# Altium schematic sheet Modules.SchDoc: Screen, LED and IR
size A4; SheetNumber: 6; SheetTotal: 7
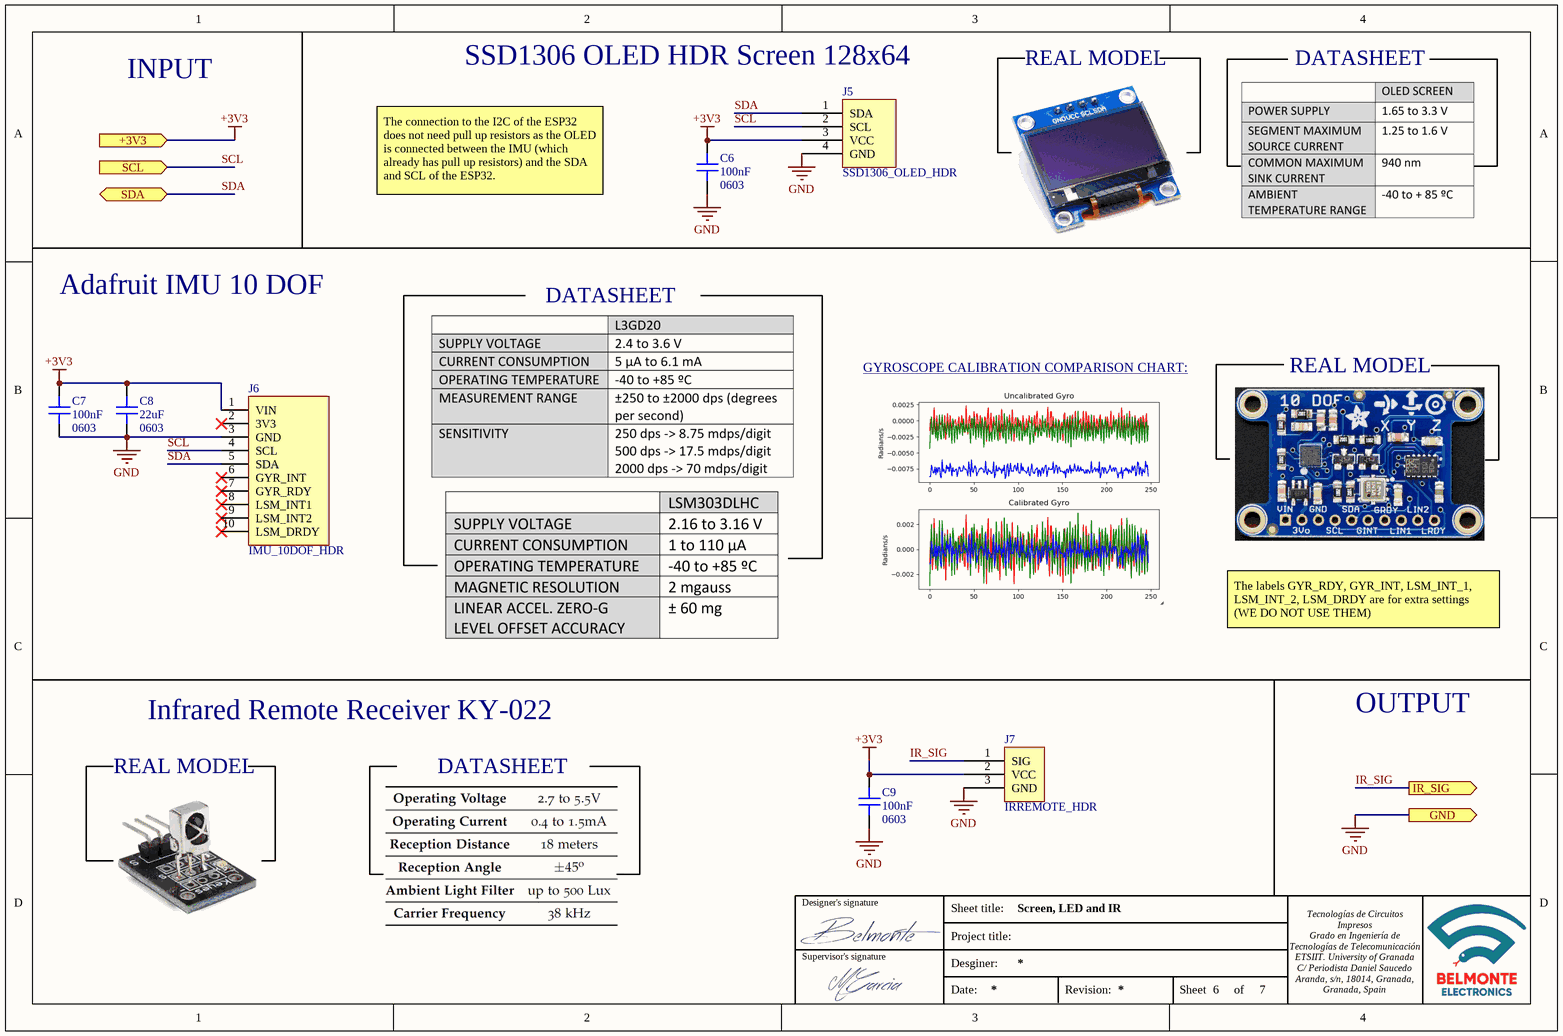
[diagram p0: Modules.SchDoc]

## Parts
C6  100nF  Size: 0603  [FP-GRM18-0_1-MFG]
C7  100nF  Size: 0603  [FP-GRM18-0_1-MFG]
C8  22uF  Size: 0603  [CAP 0603_1608]
C9  100nF  Size: 0603  [FP-GRM18-0_1-MFG]
J5  SSD1306_OLED_HDR  [OLED_guarreta]
J6  IMU_10DOF_HDR  [IMU_GUARRETA]
J7  IRREMOTE_HDR  [IRremote_guarreta]

## Ports
+3V3 (in), GND (out), IR_SIG (out), SCL (in), SDA (bidir)

## Nets
+3V3: C6.1 C7.1 C8.2 C9.1 J5.3(VCC) J6.1(VIN) J7.2(VCC) ; port +3V3
GND: C6.2 C7.2 C8.1 C9.2 J5.4(GND) J6.3(GND) J7.3(GND) ; port GND
IR_SIG: J7.1(SIG) ; port IR_SIG
SCL: J5.2(SCL) J6.4(SCL) ; port SCL
SDA: J5.1(SDA) J6.5(SDA) ; port SDA

Not connected (* = marked no-connect by the designer): J6 2(3V3)* 6(GYR_INT)* 7(GYR_RDY)* 8(LSM_INT1)* 9(LSM_INT2)* 10(LSM_DRDY)*

## Notes on the sheet
- INPUT
- (near J5) SSD1306 OLED HDR Screen 128x64
- REAL MODEL
- DATASHEET
- The connection to the I2C of the ESP32 does not need pull up resistors as the OLED is connected between the IMU (which already has pull up resistors) and the SDA and SCL of the ESP32.
- Adafruit IMU 10 DOF
- GYROSCOPE CALIBRATION COMPARISON CHART: <The chart comparing the calibrated and uncalibrated gyro has been taken from https://learn.adafruit.com/adafruit-sensorlab-gyroscope-calibration?view=all>
- The labels GYR_RDY, GYR_INT, LSM_INT_1, LSM_INT_2, LSM_DRDY are for extra settings (WE DO NOT USE THEM)
- OUTPUT
- Infrared Remote Receiver KY-022
- Designer's signature
- Sheet title:
- Supervisor's signature
- Project title:
- Desginer:
- Date:
- Revision:
- Sheet
- of
- Tecnologías de Circuitos Impresos
  Grado en Ingeniería de Tecnologías de Telecomunicación
  ETSIIT. University of Granada
  C/ Periodista Daniel Saucedo Aranda, s/n, 18014, Granada, Granada, Spain

## Library data of the parts
C6 C7 C9 = CMP-2006-02826-2: CAP CER 0.1UF 6.3V X7R 0603; Manufacturer Part Number: GRM188R70J104KA01D; Manufacturer: Murata; Symbol 0 0: Capacitor; Material: Ceramic; Value: 0.1 µF; Tolerance: 10%; Temperature Coefficient: 15%; Octopart: https://octopart.com/grm188r70j104ka01d-murata-17826949; Temperature: -55°C to +125°C; Ipc Land Pattern Name: CAPC16080X80; Lead Free: Yes; RoHS: TRUE; Device Class L2: Capacitors; Voltage Rating: 6.3V; Device Class L1: Passive Components; Package: GRM18-0.1; ComponentLink2URL: http://search.murata.co.jp/Ceramy/image/img/A01X/G101/ENG/GRM188R70J104KA01-01.pdf; Temperature Range Low: -55°C; Mouser Description: Multilayer Ceramic Capacitors MLCC - SMD/SMT 0.1uF 6.3Volts X7R 10%; ComponentLink2Description: Datasheet; Digikey Description: CAP CER 0.1UF 6.3V X7R 0603; Automotive: No; Height: 0.9mm; Voltage: 6.3V; Temperature Characteristic: X7R; Capacitance: 0.1uF; Device Class L3: Ceramic Capacitors; Category: Cap; Temperature Range High: +125°C
C8 = C1608X5R0G226M080AA: CAP CER 22UF 4V X5R 0603; Manufacturer: TDK Corporation; Capacitance: 22µF; Tolerance: ±20%; Value: 22 µF; Part Number: C1608X5R0G226M080AA; Applications: General Purpose; ComponentLink1Description: Datasheet; ComponentLink1URL: https://product.tdk.com/info/en/catalog/datasheets/mlcc_commercial_general_en.pdf?ref_disty=digikey; ComponentLink2Description: DigiKey Link; ComponentLink2URL: http://digikey.com/product-detail/en/tdk-corporation/C1608X5R0G226M080AA/445-8030-1-ND/2792156; Device Package: 0603 (1608 Metric); LastUpdated: 09/02/2020 01:03:35; Lifecycle Status: Active; Minimum Order: 1; Mounting Type: Surface Mount, MLCC; Operating Temperature: -55°C ~ 85°C; Package / Case: 0603 (1608 Metric); Packaging: TapeAndReel; PartId: 2599; Part Status: Active; Price: 0.09; Series: C; Size / Dimension: 0.063" L x 0.031" W (1.60mm x 0.80mm); Supplier 1: DigiKey; Supplier Part Number 1: 445-8030-1-ND; Temperature Coefficient: X5R; Thickness (Max): 0.039" (1.00mm); Voltage - Rated: 4V; Category: Cap
J5 = SSD_GUARRETA: CONN HDR 4POS 0.1 TIN PCB; Manufacturer: Sullins; Manufacturer Part Number: PPTC041LFBN-RC; Number of Positions: 4; Connector Type: Header,Socket; Pitch: 0.1inch; Supplier 1: Digi-Key; RoHS: Yes; Category: OLED Screen; Stock 1: 41925; Pricing 1: 1=0,45000, 10=0,42400, 100=0,32500, 500=0,28260, 1000=0,23315, 5000=0,20489, 10000=0,20410 (USD); Mount: Through Hole; Contact Plating: Tin; Contact Material: Bronze; Color: Black; Housing Material: Plastic; Termination: Solder; Package Quantity: 1000; Number of Rows: 1; Packaging: Bulk; Length: 10.7mm; Width: 2.5mm; Height: 8.5mm; Lead Free: Lead Free; ComponentLink1URL: https://media.digikey.com/pdf/Data%20Sheets/Sullins%20PDFs/Female_Headers.100_DS.pdf?src-supplier=Digi-Key; ComponentLink1Description: https://media.digikey.com/pdf/Data%20Sheets/Sullins%20PDFs/Female_Headers.100_DS.pdf?src-supplier=Digi-Key; ComponentLink2URL: http://www.sullinscorp.com/catalogs/78_Page80-81_HEADER_.100_2.54mm_FEMALE.pdf?src-supplier=Future+Electronics; ComponentLink2Description: http://www.sullinscorp.com/catalogs/78_Page80-81_HEADER_.100_2.54mm_FEMALE.pdf?src-supplier=Future+Electronics; Supplier Part Number 1: S7002-ND
J6 = IMU_GUARRETA: CONN HDR 10POS 0.1 TIN PCB; Manufacturer: Sullins; Manufacturer Part Number: PPTC101LFBN-RC; Number of Positions: 10; Connector Type: Header; Pitch: 0.1inch; Supplier 1: Digi-Key; RoHS: Yes; Category: IMU; Stock 1: 12464; Pricing 1: 1=0,65000, 10=0,57400, 100=0,49500, 500=0,40500, 1000=0,36000, 5000=0,32500 (USD); Mount: Through Hole; Color: Black; Contact Plating: Tin; Contact Material: Bronze; Housing Material: Plastic; Package Quantity: 1000; Number of Rows: 1; Packaging: Bulk; Termination: Solder; Contact Type: Female Socket; Length: 25.9mm; Width: 2.5mm; Height: 8.5mm; Lead Free: Lead Free; RoHS Compliant: Yes; ComponentLink1URL: https://media.digikey.com/pdf/Data%20Sheets/Sullins%20PDFs/Female_Headers.100_DS.pdf?src-supplier=Digi-Key; ComponentLink1Description: https://media.digikey.com/pdf/Data%20Sheets/Sullins%20PDFs/Female_Headers.100_DS.pdf?src-supplier=Digi-Key; Supplier Part Number 1: S7008-ND
J7 = IRREMOTE_GUARRETA: CONN HDR 3POS 0.1 GOLD PCB; Manufacturer: Sullins; Manufacturer Part Number: PPPC031LFBN-RC; Number of Positions: 3; Connector Type: Header; Pitch: 0.1inch; Supplier 1: Digi-Key; RoHS: Yes; Category: IR Receiver; Stock 1: 36124; Pricing 1: 1=0,37000, 10=0,35100, 100=0,26910, 500=0,23400, 1000=0,19305, 5000=0,16965, 10000=0,16900 (USD); Mount: Through Hole; Color: Black; Contact Plating: Gold; Contact Material: Bronze; Housing Material: Plastic; Package Quantity: 1000; Number of Rows: 1; Packaging: Bulk; Termination: Solder; Contact Type: Female Socket; Length: 8.12mm; Width: 2.5mm; Height: 8.5mm; Lead Free: Lead Free; RoHS Compliant: Yes; ComponentLink1URL: https://media.digikey.com/pdf/Data%20Sheets/Sullins%20PDFs/Female_Headers.100_DS.pdf?src-supplier=Digi-Key; ComponentLink1Description: https://media.digikey.com/pdf/Data%20Sheets/Sullins%20PDFs/Female_Headers.100_DS.pdf?src-supplier=Digi-Key; ComponentLink2URL: http://www.sullinscorp.com/catalogs/78_Page80-81_HEADER_.100_2.54mm_FEMALE.pdf?src-supplier=Future+Electronics; ComponentLink2Description: http://www.sullinscorp.com/catalogs/78_Page80-81_HEADER_.100_2.54mm_FEMALE.pdf?src-supplier=Future+Electronics; Supplier Part Number 1: S7036-ND